# EasyEDA Pro project RN8302B-c8t6 V3.1.eprj, board PCB1
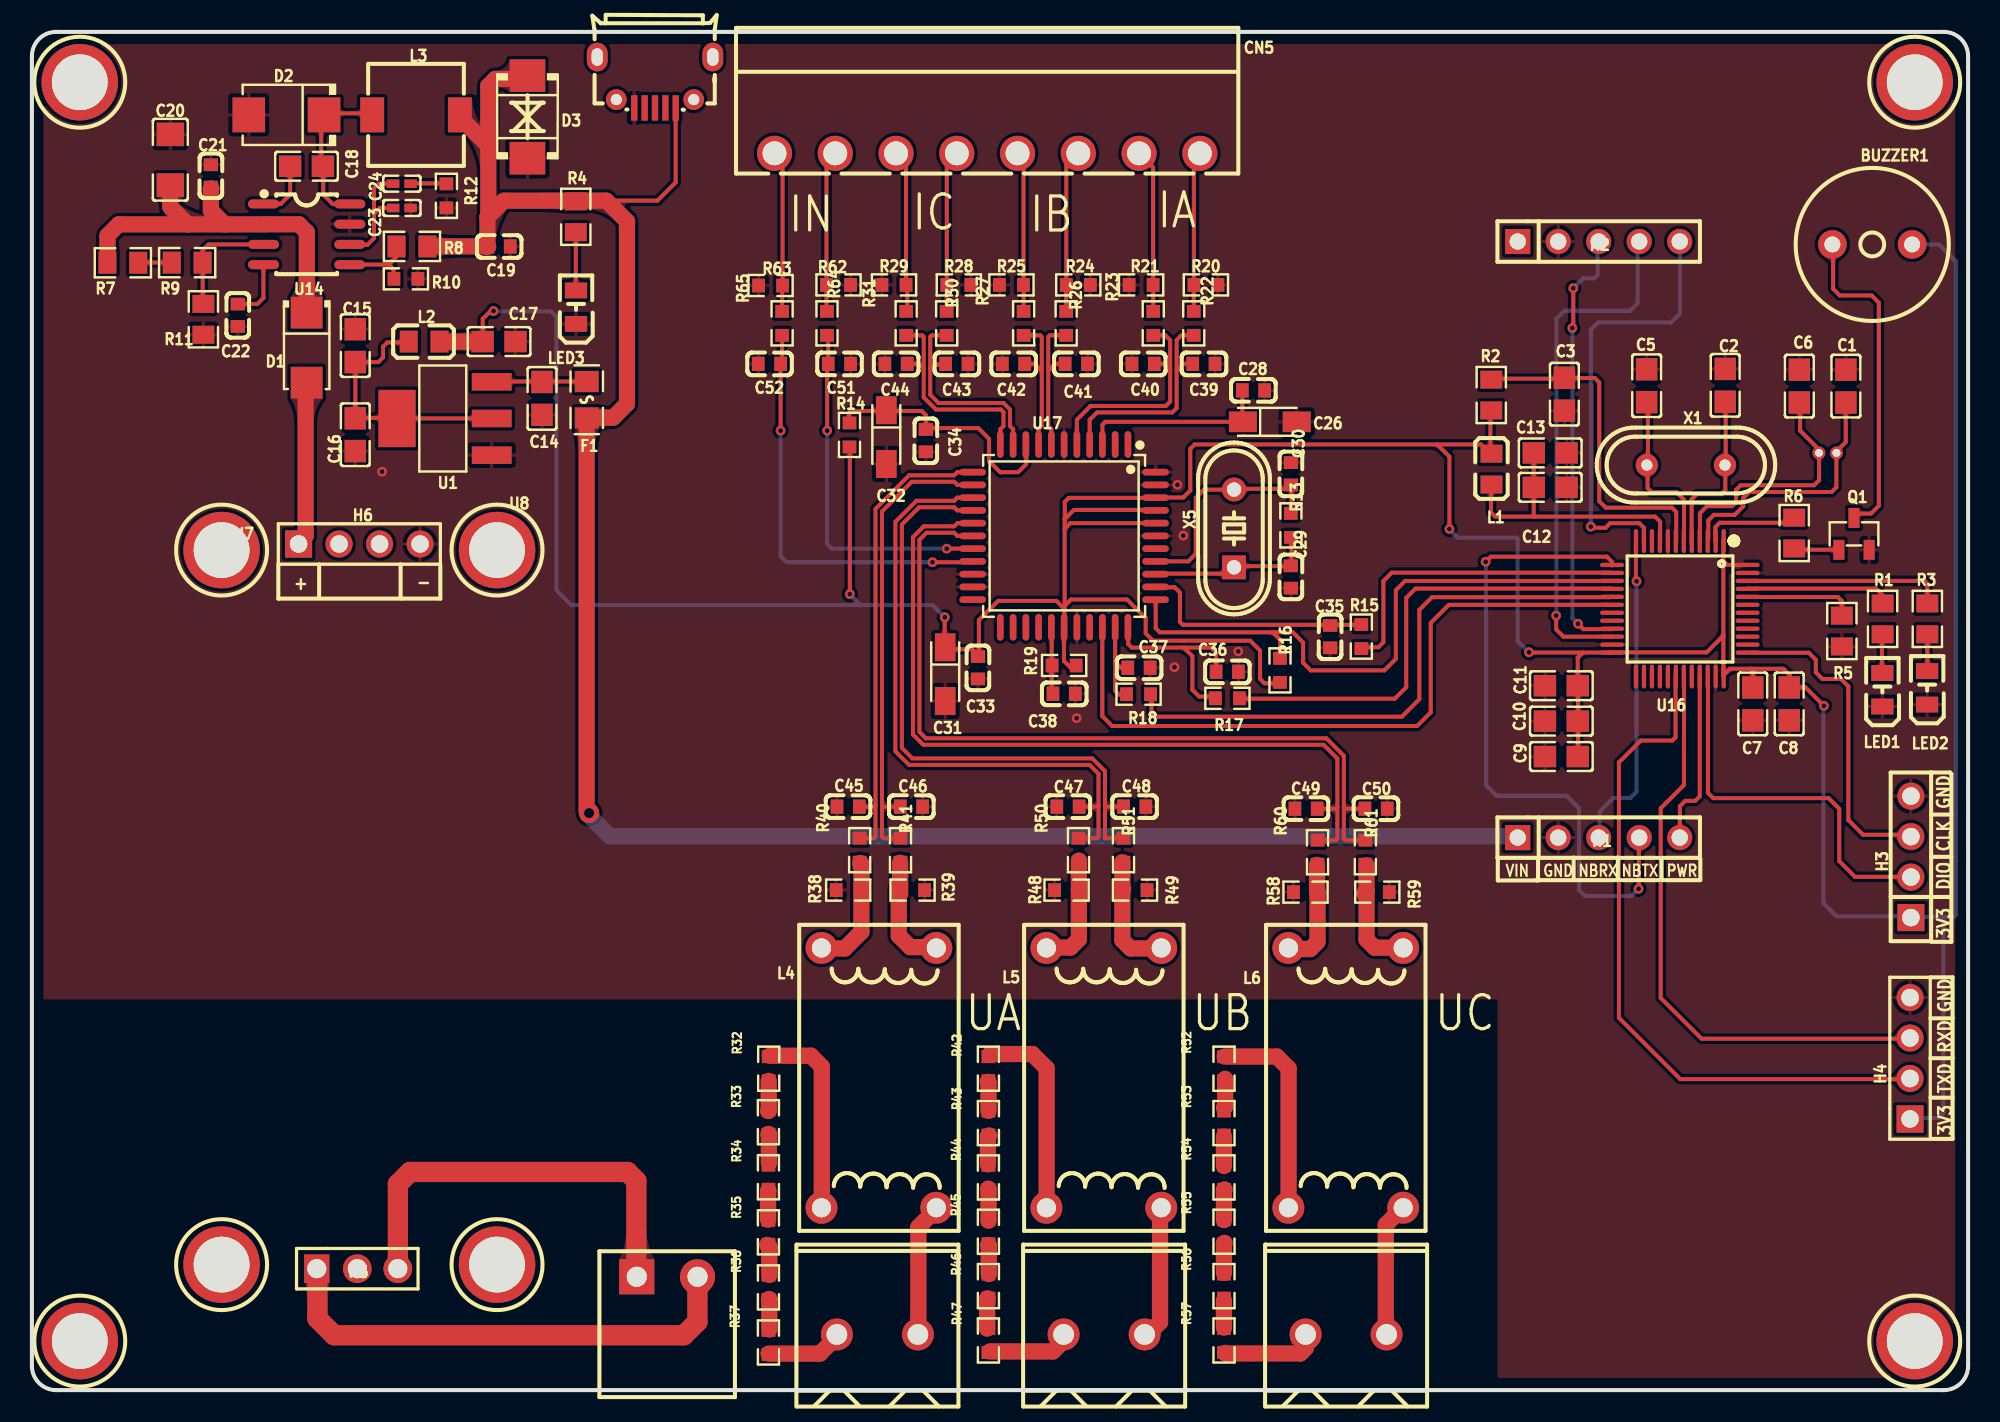
[diagram p2: board, top side]
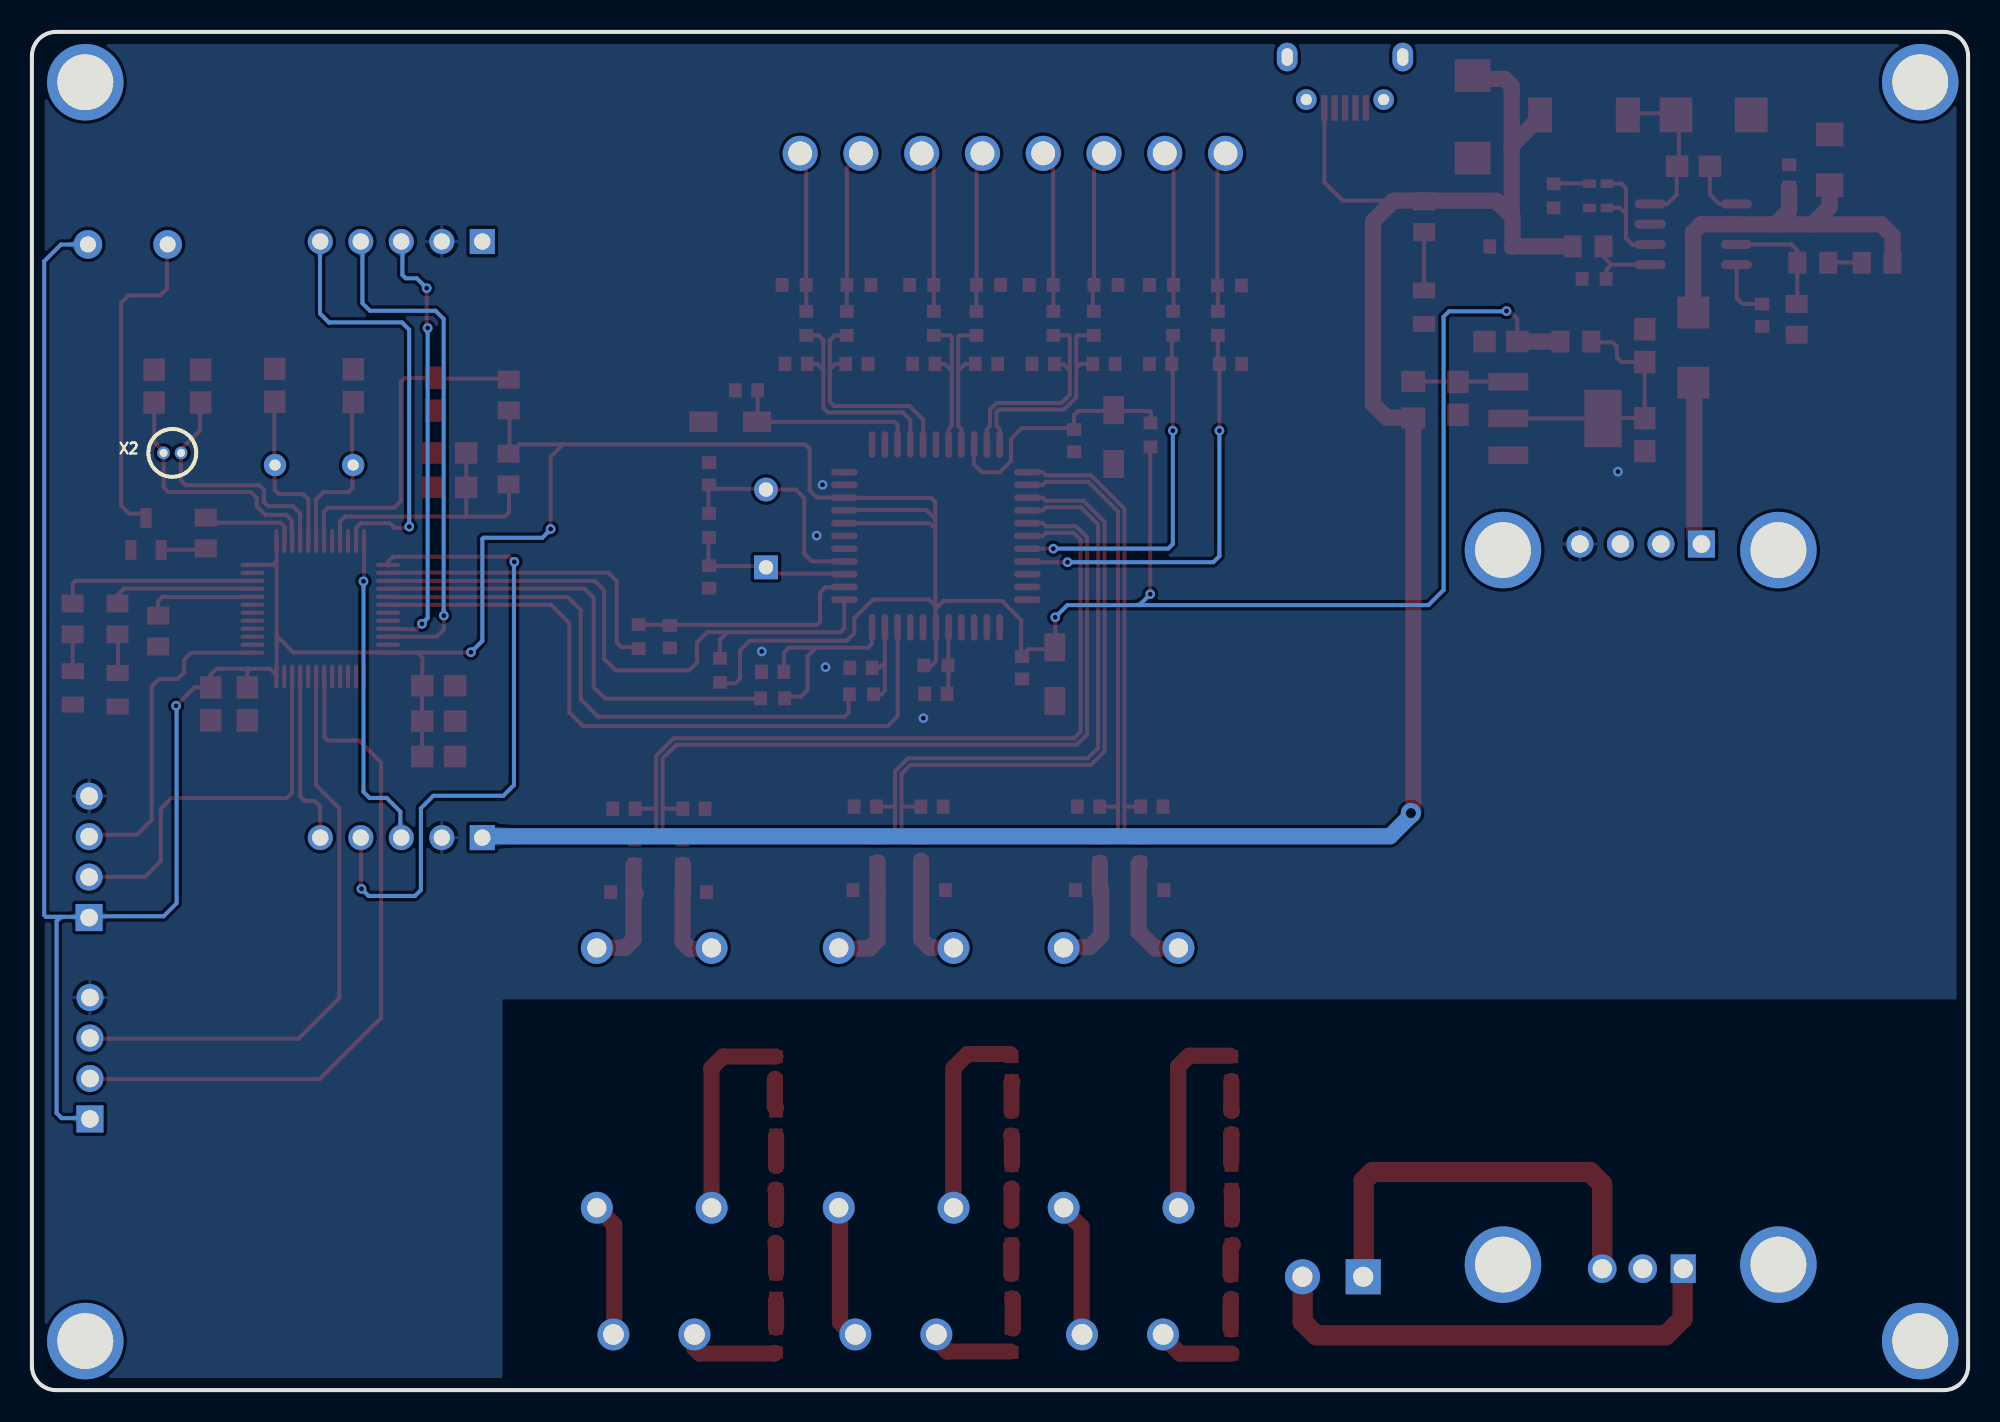
[diagram p3: board, bottom side, seen from below]

Outline 121.41 x 85.22 mm; copper layers: Top Layer, Bottom Layer. Coordinates in mm from the lower left corner of the outline.
Outline path: 0,83.69 0,1.52 arc(0.45,0.45) 1.52,0 119.89,0 arc(120.97,0.45) 121.41,1.52 121.41,83.69 arc(120.97,84.77) 119.89,85.22 1.52,85.22 arc(0.45,84.77) 0,83.69
Stack: Top Layer 0.035mm / Dielectric1 1.51mm FR4 er 4.5 / Bottom Layer 0.035mm

## Design rules (mm)
net GND: POWE
net 3V3: POWE
net VDDA: POWE
net +5V: POWE
net VIN_9V: POWE
net I1P: DP1
net I1N: DP1
net I2P: DP2
net I2N: DP2
net I3P: DP3
net I3N: DP3
net VAP: DP4
net VAN: DP4
net VBP: DP5
net VBN: DP5
net VCP: DP6
net VCN: DP6
template: 自定义配置
spacing copperThickness1oz (default): track to track 0.102, other pairs 0.152 to 0.3
spacing copperThickness2oz: track to track 0.203, other pairs 0.152 to 0.3
track width copperThickness1oz (default): min 0.127, default 0.254, max 2.54
track width copperThickness2oz: min 0.203, default 0.254, max 2.54
track width POWE: min 0.254, default 0.254, max 2.54
differential pair differentialPair (default): width min 0.127, default 0.254, max 2.54; gap min 0.152, default 0.152
via viaSize (default): diameter min 0.5, default 0.61, max 10; hole min 0.3, default 0.305, max 6.299
net class POWE uses POWE
net GND uses POWE
net 3V3 uses POWE
net VDDA uses POWE
net +5V uses POWE
net VIN_9V uses POWE

## Placement (name value [footprint] x y rotation side)
BUZZER1  KXG0903C3  [buz-th_bd9.6-p5.00-d0.7-fd]  115.4 71.88 180 top
C1  10pF  [c0805]  113.75 62.99 270 top
C2  22pF  [c0805]  106.18 63.04 270 top
C3  100nF  [c0805]  96.1 62.48 90 top
C5  22pF  [c0805]  101.26 63.02 270 top
C6  10pF  [c0805]  110.83 62.99 270 top
C7  100nF  [c0805]  107.91 43.05 90 top
C8  100nF  [c0805]  110.19 43.05 90 top
C9  100nF  [c0805]  95.91 39.75 0 top
C10  100nF  [c0805]  95.91 41.97 0 top
C11  100nF  [c0805]  95.91 44.2 0 top
C12  100nF  [c0805]  95.21 56.64 180 top
C13  22uF  [c0805]  95.21 58.8 180 top
C14  22uF  [c0805]  31.99 62.22 270 top
C15  22uF  [c0805]  20.28 65.53 90 top
C16  100nF  [c0805]  20.28 59.94 90 top
C17  22uF  [c0805]  29.29 65.79 0 top
C18  100nF  [c0805]  17.22 76.79 0 top
C19  10nF  [c0603]  29.29 71.75 180 top
C20  10uF  [c1206]  8.68 77.19 270 top
C21  10nF  [c0603]  11.22 76.18 270 top
C22  10nF  [c0603]  12.91 67.44 90 top
C23  1nF  [c0402]  23.2 74.17 180 top
C24  47pF  [c0402]  23.2 75.69 180 top
C26  10uF  [CAP-SMD_L3.2-W1.6-RD-C7171]  77.62 60.75 0 top
C28  100nF  [C0603]  76.6 62.72 0 top
C29  15pF  [C0603]  78.94 51.02 270 top
C30  15pF  [C0603]  78.95 57.49 90 top
C31  10uF  [CAP-SMD_L3.2-W1.6-RD-C7171]  57.27 44.92 270 top
C32  10uF  [CAP-SMD_L3.2-W1.6-RD-C7171]  53.58 59.79 270 top
C33  100nF  [C0603]  59.32 45.32 90 top
C34  100nF  [C0603]  56.06 59.57 90 top
C35  15pF  [C0603]  81.41 47.27 90 top
C36  15pF  [C0603]  74.96 45.07 180 top
C37  15pF  [C0603]  69.42 45.32 180 top
C38  100nF  [C0603]  64.73 43.69 180 top
C39  33nF  [C0603]  73.49 64.39 180 top
C40  33nF  [C0603]  69.68 64.39 180 top
C41  33nF  [C0603]  65.49 64.39 180 top
C42  33nF  [C0603]  61.55 64.39 180 top
C43  33nF  [C0603]  58 64.39 180 top
C44  33nF  [C0603]  54.19 64.39 180 top
C45  33nF  [C0603]  51.19 36.61 0 top
C46  33nF  [C0603]  55.15 36.61 0 top
C47  33nF  [C0603]  64.97 36.61 0 top
C48  33nF  [C0603]  69.15 36.61 0 top
C49  33nF  [C0603]  79.9 36.48 0 top
C50  33nF  [C0603]  84.29 36.48 0 top
C51  33nF  [C0603]  50.64 64.39 180 top
C52  33nF  [C0603]  46.25 64.39 180 top
CN5  WJ15EDGRC-3.81-8P  [CONN-TH_8P-P3.81_WJ15EDGRC-3.81-8P]  59.9 77.6 180 top
D1  -  [sma_l4.3-w2.6-ls5.2-rd]  17.23 65.4 270 top
D2  -  [smb_l4.6-w3.6-ls5.3-rd]  15.96 80.01 180 top
D3  -  [smb_l4.6-w3.6-ls5.3-bi]  31.07 79.88 90 top
F1  0.5A 6V  [f0805]  34.79 62.14 270 top
H1  PM254-1-05-Z-8.5  [HDR-TH_5P-P2.54-V-F]  98.25 34.67 0 top
H2  PM254-1-05-Z-8.5  [HDR-TH_5P-P2.54-V-F]  98.25 72.06 0 top
H3  -  [hdr-th_4p-p2.54-v-m]  117.83 33.46 90 top
H4  -  [hdr-th_4p-p2.54-v-m-1]  117.77 20.82 90 top
H5  Z-211-0311-0021-001  [hdr-th_3p-p2.54-v-m-1_1]  20.4 7.62 0 top
H6  -  [hdr-th_4p-p2.54-v-m-1]  20.53 53.09 0 top
L1  10uH  [l0805]  91.52 57.78 270 top
L2  10uH  [l0805]  24.6 65.79 0 top
L3  6.8uH  [ind-smd_l6.0-w6.0_slf6025]  24.09 80.01 0 top
L4  ZMPT107-1  [XFMR-TH_ZMPT107-1]  53.11 19.59 90 top
L5  ZMPT107-1  [XFMR-TH_ZMPT107-1]  67.22 19.59 90 top
L6  ZMPT107-1  [XFMR-TH_ZMPT107-1]  82.39 19.59 90 top
LED1  RED  [led0805-r-rd]  116.04 43.94 90 top
LED2  BLUE  [led0805-r-rd]  118.84 44.06 90 top
LED3  RED  [led0805-r-rd]  34.12 67.94 90 top
P1  WJ15EDGRC-3.81-2P  [conn-th_2p-p3.81_wj15edgrc-3.81-2p]  39.84 7.11 0 top
P2  WJ500V-5.08-2P  [CONN-TH_2P-P5.00_WJ500V-5.08-2P]  53.02 3.49 0 top
P3  WJ500V-5.08-2P  [CONN-TH_2P-P5.00_WJ500V-5.08-2P]  67.24 3.49 0 top
P4  WJ500V-5.08-2P  [CONN-TH_2P-P5.00_WJ500V-5.08-2P]  82.41 3.49 0 top
Q1  S8050  [sot-23-3_l2.9-w1.3-p1.90-ls2.4-br]  114.26 53.72 270 top
R1  470  [r0805]  116.05 48.39 270 top
R2  10k  [r0805]  91.51 62.43 270 top
R3  470  [r0805]  118.86 48.39 270 top
R4  1k  [r0805]  34.11 73.62 90 top
R5  10k  [r0805]  113.5 47.62 90 top
R6  330  [r0805]  110.51 53.77 90 top
R7  2k  [r0805]  5.7 70.73 180 top
R8  51k  [r0805]  23.83 71.75 0 top
R9  330k  [r0805]  9.74 70.74 180 top
R10  10k  [r0603]  23.45 69.72 180 top
R11  51k  [r0805]  10.75 67.18 90 top
R12  -  [r0603]  25.99 74.93 270 top
R13  10MΩ  [R0603]  78.95 54.25 270 top
R14  10Ω  [R0603]  51.27 59.93 90 top
R15  10Ω  [R0603]  83.36 47.28 270 top
R16  10kΩ  [R0603]  78.26 45.16 270 top
R17  10Ω  [R0603]  74.97 43.4 0 top
R18  10Ω  [R0603]  69.39 43.66 0 top
R19  10kΩ  [R0603]  64.73 45.47 180 top
R20  3Ω  [R0603]  73.62 69.34 180 top
R21  3Ω  [R0603]  69.55 69.34 180 top
R22  1kΩ  [R0603]  72.86 66.93 270 top
R23  1kΩ  [R0603]  70.32 66.93 270 top
R24  3Ω  [R0603]  65.62 69.34 180 top
R25  3Ω  [R0603]  61.43 69.34 180 top
R26  1kΩ  [R0603]  64.85 66.93 270 top
R27  1kΩ  [R0603]  62.19 66.93 270 top
R28  3Ω  [R0603]  58.12 69.34 180 top
R29  3Ω  [R0603]  54.06 69.34 180 top
R30  1kΩ  [R0603]  57.36 66.93 270 top
R31  1kΩ  [R0603]  54.82 66.93 270 top
R32  33kΩ  [R0603]  46.2 20.17 270 top
R33  33kΩ  [R0603]  46.19 16.81 270 top
R34  33kΩ  [R0603]  46.19 13.36 270 top
R35  33kΩ  [R0603]  46.19 9.9 270 top
R36  33kΩ  [R0603]  46.19 6.45 270 top
R37  33kΩ  [R0603]  46.19 2.99 270 top
R38  49.9Ω  [R0603]  51.19 31.37 0 top
R39  49.9Ω  [R0603]  55.22 31.37 0 top
R40  1kΩ  [R0603]  51.91 33.88 90 top
R41  1kΩ  [R0603]  54.47 33.88 90 top
R42  33kΩ  [R0603]  59.98 20.17 270 top
R43  33kΩ  [R0603]  59.98 16.76 270 top
R44  33kΩ  [R0603]  59.98 13.35 270 top
R45  33kΩ  [R0603]  59.98 9.94 270 top
R46  33kΩ  [R0603]  59.98 6.53 270 top
R47  33kΩ  [R0603]  59.98 3.12 270 top
R48  49.9Ω  [R0603]  64.88 31.37 0 top
R49  49.9Ω  [R0603]  69.17 31.37 0 top
R50  1kΩ  [R0603]  65.63 33.88 90 top
R51  1kΩ  [R0603]  68.45 33.88 90 top
R52  33kΩ  [R0603]  74.75 20.17 270 top
R53  33kΩ  [R0603]  74.75 16.76 270 top
R54  33kΩ  [R0603]  74.75 13.35 270 top
R55  33kΩ  [R0603]  74.75 9.94 270 top
R56  33kΩ  [R0603]  74.75 6.53 270 top
R57  33kΩ  [R0603]  74.75 3.12 270 top
R58  49.9Ω  [R0603]  79.86 31.24 0 top
R59  49.9Ω  [R0603]  84.36 31.24 0 top
R60  1kΩ  [R0603]  80.62 33.75 90 top
R61  1kΩ  [R0603]  83.62 33.75 90 top
R62  3Ω  [R0603]  50.58 69.34 180 top
R63  3Ω  [R0603]  46.32 69.3 180 top
R64  1kΩ  [R0603]  49.86 66.93 270 top
R65  1kΩ  [R0603]  47.04 66.93 270 top
U1  -  [sot-223-3_l6.5-w3.4-p2.30-ls7.0-br]  25.87 60.96 0 top
U3  -  [smd_bd4.2-l4.7-w4.7-d3.0]  118.06 82.06 0 top
U4  -  [smd_bd4.2-l4.7-w4.7-d3.0]  118.06 3.08 0 top
U5  -  [smd_bd4.2-l4.7-w4.7-d3.0]  3 3.08 0 top
U6  -  [smd_bd4.2-l4.7-w4.7-d3.0]  3 82.06 0 top
U7  -  [smd_bd4.2-l4.7-w4.7-d3.0]  11.9 52.7 180 top
U8  -  [smd_bd4.2-l4.7-w4.7-d3.0]  29.17 52.7 180 top
U9  -  [smd_bd4.2-l4.7-w4.7-d3.0]  29.17 7.87 0 top
U10  -  [smd_bd4.2-l4.7-w4.7-d3.0]  11.9 7.87 0 top
U14  -  [soic-8_l5.0-w4.0-p1.27-ls6.0-bl]  17.23 72.52 270 top
U16  STM32F103C8T6  [lqfp-48_l7.0-w7.0-p0.50-ls9.0-bl_4]  103.34 49.02 180 top
U17  RN8302B  [LQFP-44_L10.0-W10.0-P0.80-LS12.0-BL]  64.73 53.59 180 top
USB2  MicroXNJ  [micro-usb-smd_microxnj_1]  39.07 82.04 180 top
X1  8MHz  [osc-th_l11.1-w4.7-p4.88]  103.72 58.04 0 top
X2  32.768KHz  [osc-th_bd3.0-p1.10-d0.4]  112.61 58.8 0 bottom
X5  8.192MHz  [HC-49US_L11.5-W4.5-P4.88]  75.38 54.06 90 top

## Footprints (pads in the part's own frame, mm; a bottom-side part is the same pattern mirrored in y, then rotated)
buz-th_bd9.6-p5.00-d0.7-fd
  round 1.8 hole 1: 1(-2.5,0) 2(2.5,0)
c0402
  rect 0.79x0.54 smd: 1(-0.545,0) 2(0.545,0)
C0603
  rect 0.8x0.9 smd: 1(-0.7,0) 2(0.7,0)
c0603
  rect 0.8x0.9 smd: 1(-0.7,0) 2(0.7,0)
c0805
  rect 1.41x1.35 smd: 1(-1.03,0) 2(1.03,0)
c1206
  rect 1.485x1.728 smd: 1(-1.593,0) 2(1.593,0)
CAP-SMD_L3.2-W1.6-RD-C7171
  rect 1.758x1.296 smd: 1(-1.687,0) 2(1.687,0)
conn-th_2p-p3.81_wj15edgrc-3.81-2p
  rect 2.2x2.2 hole 1.26: 1(-1.905,0)
  round 2.2 hole 1.26: 2(1.905,0)
CONN-TH_2P-P5.00_WJ500V-5.08-2P
  round 2 hole 1.3: 1(-2.54,0) 2(2.54,0)
CONN-TH_8P-P3.81_WJ15EDGRC-3.81-8P
  round 2.2 hole 1.5: 1(-13.335,0) 2(-9.525,0) 3(-5.715,0) 4(-1.905,0) 5(1.905,0) 6(5.715,0) 7(9.525,0) 8(13.335,0)
f0805
  rect 1.335x1.5 smd: 1(-1.143,0) 2(1.143,0)
HC-49US_L11.5-W4.5-P4.88
  rect 1.5x1.5 hole 0.9: 1(-2.44,0)
  round 1.5 hole 0.9: 2(2.44,0)
hdr-th_3p-p2.54-v-m-1_1
  rect 1.575x1.8 hole 1.2: 1(-2.54,0)
  round 1.8 hole 1.2: 2(0,0) 3(2.54,0)
hdr-th_4p-p2.54-v-m
  rect 1.7x1.7 hole 1.1: 1(-3.81,0)
  round 1.7 hole 1.1: 2(-1.27,0) 3(1.27,0) 4(3.81,0)
hdr-th_4p-p2.54-v-m-1
  rect 1.7x1.7 hole 1.1: 1(-3.81,0)
  round 1.7 hole 1.1: 2(-1.27,0) 3(1.27,0) 4(3.81,0)
HDR-TH_5P-P2.54-V-F
  rect 1.575x1.575 hole 1.02: 1(-5.08,0)
  round 1.575 hole 1.02: 2(-2.54,0) 3(0,0) 4(2.54,0) 5(5.08,0)
ind-smd_l6.0-w6.0_slf6025
  rect 1.501x2.2 smd: 1(-2.751,0) 2(2.751,0)
l0805
  rect 1.133x1.377 smd: 1(-0.966,0) 2(0.966,0)
led0805-r-rd
  rect 1x1.399 smd: 1(1.05,0) 2(-1.05,0)
LQFP-44_L10.0-W10.0-P0.80-LS12.0-BL
  oval 0.42x1.67 smd: 1(-4,-5.735) 2(-3.2,-5.735) 3(-2.4,-5.735) 4(-1.6,-5.735) 5(-0.8,-5.735) 6(0,-5.735) 7(0.8,-5.735) 8(1.6,-5.735) 9(2.4,-5.735) 10(3.2,-5.735) 11(4,-5.735) 23(4,5.735) 24(3.2,5.735) 25(2.4,5.735) 26(1.6,5.735) 27(0.8,5.735) 28(0,5.735) 29(-0.8,5.735) 30(-1.6,5.735) 31(-2.4,5.735) 32(-3.2,5.735) 33(-4,5.735)
  oval 1.67x0.42 smd: 12(5.735,-4) 13(5.735,-3.2) 14(5.735,-2.4) 15(5.735,-1.6) 16(5.735,-0.8) 17(5.735,0) 18(5.735,0.8) 19(5.735,1.6) 20(5.735,2.4) 21(5.735,3.2) 22(5.735,4) 34(-5.735,4) 35(-5.735,3.2) 36(-5.735,2.4) 37(-5.735,1.6) 38(-5.735,0.8) 39(-5.735,0) 40(-5.735,-0.8) 41(-5.735,-1.6) 42(-5.735,-2.4) 43(-5.735,-3.2) 44(-5.735,-4)
lqfp-48_l7.0-w7.0-p0.50-ls9.0-bl_4
  oval 0.27x1.5 smd: 1(-2.75,-4.25) 2(-2.25,-4.25) 3(-1.75,-4.25) 4(-1.25,-4.25) 5(-0.75,-4.25) 6(-0.25,-4.25) 7(0.25,-4.25) 8(0.75,-4.25) 9(1.25,-4.25) 10(1.75,-4.25) 11(2.25,-4.25) 12(2.75,-4.25) 25(2.75,4.25) 26(2.25,4.25) 27(1.75,4.25) 28(1.25,4.25) 29(0.75,4.25) 30(0.25,4.25) 31(-0.25,4.25) 32(-0.75,4.25) 33(-1.25,4.25) 34(-1.75,4.25) 35(-2.25,4.25) 36(-2.75,4.25)
  oval 1.5x0.27 smd: 13(4.25,-2.75) 14(4.25,-2.25) 15(4.25,-1.75) 16(4.25,-1.25) 17(4.25,-0.75) 18(4.25,-0.25) 19(4.25,0.25) 20(4.25,0.75) 21(4.25,1.25) 22(4.25,1.75) 23(4.25,2.25) 24(4.25,2.75) 37(-4.25,2.75) 38(-4.25,2.25) 39(-4.25,1.75) 40(-4.25,1.25) 41(-4.25,0.75) 42(-4.25,0.25) 43(-4.25,-0.25) 44(-4.25,-0.75) 45(-4.25,-1.25) 46(-4.25,-1.75) 47(-4.25,-2.25) 48(-4.25,-2.75)
micro-usb-smd_microxnj_1
  rect 0.4x1.6 smd: 1(-1.3,1.597) 2(-0.65,1.597) 3(0,1.597) 4(0.65,1.597) 5(1.3,1.597)
  round 1.3 hole 0.7: 6(2.425,1.074) 9(-2.425,1.073)
  oval 1.3x1.8 hole 0.7x1.1: 7(3.625,-1.597) 8(-3.625,-1.597)
osc-th_bd3.0-p1.10-d0.4
  round 0.8 hole 0.5: 1(-0.548,0) 2(0.551,0)
osc-th_l11.1-w4.7-p4.88
  round 1.4 hole 0.7: 1(-2.45,0) 2(2.45,0)
R0603
  rect 0.806x0.864 smd: 1(-0.753,0) 2(0.753,0)
r0603
  rect 0.806x0.864 smd: 1(-0.753,0) 2(0.753,0)
r0805
  rect 1.133x1.377 smd: 1(-0.966,0) 2(0.966,0)
sma_l4.3-w2.6-ls5.2-rd
  rect 2x2 smd: 1(-2.2,0) 2(2.2,0)
smb_l4.6-w3.6-ls5.3-bi
  rect 2.047x2.241 smd: 1(-2.591,0) 2(2.591,0)
smb_l4.6-w3.6-ls5.3-rd
  rect 2.047x2.192 smd: 1(-2.361,0) 2(2.361,0)
smd_bd4.2-l4.7-w4.7-d3.0
  round 4.8 hole 3.5: 1(0,0)
soic-8_l5.0-w4.0-p1.27-ls6.0-bl
  oval 0.569x1.95 smd: 1(-1.905,-2.705) 2(-0.635,-2.705) 3(0.635,-2.705) 4(1.905,-2.705) 5(1.905,2.705) 6(0.635,2.705) 7(-0.635,2.705) 8(-1.905,2.705)
sot-23-3_l2.9-w1.3-p1.90-ls2.4-br
  rect 1.25x0.7 smd: 1(1,-0.95) 2(1,0.95) 3(-1,0)
sot-223-3_l6.5-w3.4-p2.30-ls7.0-br
  rect 2.5x1.1 smd: 1(2.97,-2.3) 2(2.97,0) 3(2.97,2.3)
  rect 2.34x3.6 smd: 4(-2.97,0)
XFMR-TH_ZMPT107-1
  round 2 hole 1.2: 1(-8.15,3.6) 2(-8.15,-3.6) 3(8.15,3.6) 4(8.15,-3.6)

## Nets
As in the schematic.

Pads without a net: H2 1; H5 2; H6 2 3; U3 1; U4 1; U5 1; U6 1; U7 1; U8 1; U9 1; U10 1; U16 10 19 20 25 26 27 28 29 32 38 39 40 41 42 43; U17 1 2 22 23 24 25 26 30 38; USB2 2 3 4 6 7 8 9

## Via types
v1: diameter 0.61, hole 0.305, Top Layer to Bottom Layer, 24 vias
v2: diameter 1.27, hole 0.635, Top Layer to Bottom Layer, 1 via

## Routing (per net, layer and track width the routed paths; a pad name or vN(x,y) marks a point on that pad's centre or on a via; arc(x,y) is an arc through that point)
3V3: length 284
  Top Layer w0.254: 110.18,44.07 110.22,44.12 110.22,44.86 109.83,45.26 107.79,45.26 ; 91.54,58.66 90.86,59.33 88.12,59.33 ; 88.12,59.33 72.91,59.33 72.64,59.06 72.64,56.44 72.2,56 70.3,56 ; 88.12,59.33 88.89,58.57 v1(88.89,54.03) ; 64.76,54.04 65.11,54.39 70.47,54.39 70.49,54.42 ; 64.76,54.04 64.76,54.65 64.77,54.65 ; 64.76,54.04 64.76,49.2 ; 91.46,61.7 91.46,58.86 91.53,58.79 ; 106.07,44.84 106.47,45.24 106.47,45.26 107.79,45.26 ; 106.07,44.84 106.07,47.33 ; 106.07,44.84 106.07,44.83 ; 106.07,52.01 106.07,47.33 ; 106.07,52.01 106.3,51.78 107.56,51.78 ; 106.07,52.01 106.07,53.32 ; 106.07,47.33 105.02,46.29 99.07,46.29 ; 96.93,44.02 96.93,45.96 97.25,46.28 ; 96.93,44.02 96.95,44 96.95,39.77 96.97,39.75 ; 96.93,44.02 96.9,43.98 ; v1(28.95,67.7) 28.76,67.7 28.27,67.21 28.27,65.92 28.33,65.86 ; 64.74,49.02 64.24,49.52 60.59,49.52 59.38,48.31 59.38,46.05 58.95,46.48 57.24,46.48 57.24,48.4 ; 64.74,49.02 64.75,49.01 ; 64.74,49.02 64.74,47.79 ; 107.79,45.26 107.91,45.14 107.91,44.04 107.9,44.03 ; 70.47,55.98 65.02,55.98 64.77,55.73 64.77,54.65 ; 64.77,54.65 64.77,54.5 ; 64.77,54.65 65.34,55.22 70.49,55.22 ; 64.76,49.2 65.16,49.6 68.67,49.6 69.84,48.43 69.84,47.48 70.3,47.02 76.39,47.02 77.01,46.4 77.01,44.62 77.29,44.35 78.22,44.35 ; 64.76,49.2 64.76,49.12 ; 64.76,49.2 64.68,49.12 ; 110.22,44.1 111.21,44.1 v1(112.37,42.93) ; 65.46,45.35 65.11,45.35 64.72,45.74 64.72,47.8 ; 51.19,59.22 51.29,59.12 v1(51.29,49.94) ; 99.15,46.28 97.25,46.28 ; 97.25,46.28 93.9,46.28 93.9,46.27 ; 78.28,44.35 78.28,44.35 78.22,44.35 ; 78.28,44.35 78.31,44.31 ; 78.28,44.35 78.22,44.35
  Top Layer w1.016: 25.57,65.78 28.24,65.78 28.27,65.81
  Bottom Layer w0.254: 117.81,29.73 113.16,29.73 112.34,30.55 112.34,42.86 ; v1(93.88,46.29) 93.17,47.01 93.17,53.4 93.09,53.48 89.4,53.48 88.89,54 ; 51.96,49.25 56.48,49.25 v1(57.24,48.49) ; 51.96,49.25 33.84,49.25 32.89,50.2 32.89,67.35 32.55,67.68 28.95,67.68 ; 51.96,49.25 51.29,49.93 ; 117.75,17.06 119.55,17.06 119.86,17.38 119.86,29.42 119.59,29.69 ; 117.87,71.94 117.94,71.88 119.59,71.88 120.64,70.82 120.64,29.81 120.53,29.69 119.59,29.69 ; 119.59,29.69 117.78,29.69
+5V: length 136.4
  Top Layer w0.254: 36.02,74.63 39.23,74.63 40.37,75.77 40.37,80.52
  Top Layer w1.016: 28.62,78.08 28.62,81.82 29.06,82.27 30.9,82.27 31.09,82.46 ; 28.62,78.08 26.71,79.98 ; 28.62,78.08 28.62,73.65 ; 28.62,73.65 29.59,74.63 34.15,74.63 ; 28.62,73.65 28.62,73.63 ; 28.62,73.65 28.57,73.6 28.57,71.77 28.55,71.76 ; 28.61,71.73 28.58,71.76 28.55,71.76 ; 24.82,71.76 28.55,71.76 ; v2(34.94,36.2) 34.79,36.36 34.79,60.83 ; 34.15,74.63 36.02,74.63 37.32,73.33 37.32,61.88 36.45,61.01 34.78,61.01
  Bottom Layer w1.016: 35,36 36.25,34.75 93.18,34.75 93.27,34.66
GND:
  vias: v1(21.96,57.63) v1(65.51,42.16) v1(71.65,45.36) v1(71.83,56.8) v1(72.2,53.61) v1(75.65,46.35)
VDDA: length 16
  Top Layer w0.254: 60.74,57.57 60.02,58.29 60.02,59.68 59.34,60.36 56.04,60.36 56.07,60.38 56.07,61.16 55.8,61.43 51.32,61.43 51.24,61.36 51.24,60.84 ; 62.35,59.3 62.35,58.1 61.85,57.59 60.74,57.59
VDDA_32: length 17.9
  Top Layer w0.254: 94.25,54.81 94.17,54.89 94.17,58.83 94.16,58.84 ; 94.25,54.81 91.76,54.81 91.49,55.08 91.49,56.78 ; 94.25,54.81 94.26,54.8 ; 102.1,53.26 102.1,54.49 101.79,54.81 94.26,54.81
VIN_9V: length 25.4
  Top Layer w1.016: 14.55,73.14 16.75,73.14 17.24,72.65 17.24,67.63 17.19,67.58 ; 11.26,75.39 11.22,75.36 11.22,74.01 12.09,73.14 ; 9.77,73.14 8.68,74.23 8.68,75.6 ; 9.77,73.14 5.44,73.14 4.74,72.43 4.74,70.71 4.72,70.7 ; 9.77,73.14 12.09,73.14 ; 12.09,73.14 14.53,73.14
CLK: length 12.4
  Top Layer w0.254: 74.14,43.45 74.07,43.52 73.19,43.52 72.77,43.94 72.77,46.05 72.23,46.59 ; 72.23,46.59 68.97,46.59 68.75,46.8 68.75,47.89 ; 72.23,46.59 73.94,46.59 74.26,46.27 74.26,45.18 74.24,45.16 ; 74.18,43.64 74.21,43.67
CS: length 39.1
  Top Layer w0.254: 99.11,50.77 86.11,50.77 85.53,50.19 85.53,45.88 84.81,45.16 80.19,45.16 79.71,45.64 79.71,46.9 79.07,47.55 77.84,47.55 ; 78.28,45.77 78.27,45.78 78.27,47.09 77.81,47.55 70.72,47.55 70.47,47.8 70.47,49.6
DI: length 15.1
  Top Layer w0.254: 83.39,47.99 83.36,48.01 81.33,48.01 ; 70.42,50.37 71.66,50.37 71.99,50.04 71.99,48.2 72.17,48.01 81.33,48.01 ; 81.33,48.01 81.4,47.95
DO: length 5.8
  Top Layer w0.254: 67.93,45.67 67.93,43.87 68.15,43.65 68.67,43.65 68.69,43.66 ; 67.93,45.67 68.3,45.3 68.67,45.3 68.72,45.35 ; 67.93,45.67 67.93,47.85
I1N: length 14.1
  Top Layer w0.254: 71.38,64.03 71.02,64.39 C40.1 ; 71.38,64.03 71.38,65.88 71.08,66.18 R23.2 ; 71.38,64.03 71.38,62.02 71.1,61.75 66.39,61.75 65.53,60.89 U17.5
I1N_IN: length 10.3
  Top Layer w0.254: R23.1 70.32,69.33 R21.1 70.31,76.72 CN5.2
I1P: length 13.9
  Top Layer w0.254: U17.4 66.33,60.88 66.79,61.34 71.51,61.34 71.78,61.61 71.78,63.99 ; C39.2 72.18,64.39 71.78,63.99 ; 71.78,63.99 71.78,65.88 72.08,66.18 R22.2
I1P_IN: length 10.1
  Top Layer w0.254: R22.1 72.86,69.33 R20.2 72.86,77.22 73.24,77.6
I2N: length 9.2
  Top Layer w0.254: U17.8 63.13,60.29 63.32,60.49 63.32,66.09 63.23,66.18 R27.2 ; 63.32,63.99 63.28,63.99 62.88,64.39 C42.1
I2N_IN: length 10.1
  Top Layer w0.254: CN5.4 62.18,77.22 R25.1 62.19,69.33 R27.1
I2P: length 9.2
  Top Layer w0.254: C41.2 64.16,64.39 63.81,64.04 63.74,64.04 ; U17.7 63.93,60.29 63.73,60.49 63.73,66.09 63.82,66.18 R26.2
I2P_IN: length 10.2
  Top Layer w0.254: CN5.3 64.86,76.84 R24.2 64.85,69.33 R26.1
I3N: length 13.6
  Top Layer w0.254: 55.91,64.12 55.64,64.39 C44.1 ; U17.11 60.73,60.29 60.92,60.49 60.92,61.36 60.76,61.53 56.68,61.53 55.92,62.29 55.92,66.09 55.83,66.18 R31.2
I3N_IN: length 10.1
  Top Layer w0.254: CN5.6 54.81,76.97 R29.1 ; 54.89,67.74 54.89,69.34
I3P: length 13.5
  Top Layer w0.254: 56.33,64.09 56.33,66.09 56.42,66.18 R30.2 ; 56.33,64.09 56.44,64.09 56.7,64.34 57.25,64.34 57.3,64.39 ; 56.33,64.09 56.33,62.45 56.85,61.93 60.92,61.93 61.33,61.53 61.33,60.49 61.53,60.29 U17.10
I3P_IN: length 10.2
  Top Layer w0.254: CN5.5 57.37,76.97 R28.2 57.36,69.33 R30.1
INN: length 26.1
  Top Layer w0.254: 46.95,60.2 C52.1 47.04,64.48 R65.2 ; 58.99,51.99 58.94,51.94 v1(56.47,51.94)
  Bottom Layer w0.254: v1(46.95,60.2) 46.95,52.32 47.33,51.94 v1(56.47,51.94)
INN_IN: length 10.1
  Top Layer w0.254: CN5.8 47.07,77.09 R63.1 47.04,69.27 R65.1
INP: length 22.4
  Top Layer w0.254: U17.18 v1(57.36,52.79) ; R64.2 49.94,66.1 C51.2 49.87,64.32 v1(49.87,60.2)
  Bottom Layer w0.254: v1(49.87,60.2) 49.87,53.09 50.16,52.79 v1(57.36,52.79)
INP_IN: length 10.2
  Top Layer w0.254: R64.1 49.83,67.71 R62.2 49.83,77.05 CN5.7
INTIN: length 44.2
  Top Layer w0.254: 67.12,47.8 67.12,42.28 67.74,41.67 86.86,41.67 87.72,42.52 87.72,48.13 88.85,49.27 99.1,49.27
L_IN: length 26.9
  Top Layer w1.27: 37.9,7.07 37.9,13.13 37.35,13.69 23.71,13.69 22.95,12.93 22.95,7.6
LED1: length 8.6
  Top Layer w0.254: 107.58,50.29 115.64,50.29 116.04,49.89
LED2: length 12.6
  Top Layer w0.254: 107.57,50.77 118.69,50.77 118.85,50.6 118.85,49.37
N: length 30.6
  Top Layer w1.27: 41.75,7.12 41.73,7.11 41.73,4.29 40.88,3.44 18.95,3.44 17.9,4.49 17.9,7.64
NRST: length 21.6
  Top Layer w0.254: 91.53,63.46 96.24,63.46 96.28,63.5 ; 96.28,63.5 98.01,63.5 98.28,63.22 98.28,55.77 98.69,55.37 102.84,55.37 103.11,55.1 103.11,53.23 ; 96.28,63.5 96.01,63.5
OSC32_IN: length 16
  Top Layer w0.254: 113.2,58.77 113.15,58.73 113.15,56.65 112.85,56.35 107.69,56.35 107.31,55.97 107.31,55.45 106.78,54.91 105.47,54.91 105.12,54.56 105.12,53.38 ; 113.74,62.01 113.74,59.48 113.1,58.84
OSC32_OUT: length 15.8
  Top Layer w0.254: 110.87,61.93 110.87,60.2 112.12,58.95 112.12,58.92 ; 104.6,53.23 104.6,55.02 105.04,55.46 106.61,55.46 106.86,55.72 106.86,56.48 107.15,56.77 111.76,56.77 112.07,57.09 112.07,58.78 112.06,58.79
OSC_IN: length 10.9
  Top Layer w0.254: 106.06,58.07 106.16,58.18 ; 106.16,58.18 106.19,58.15 106.19,56.47 105.93,56.21 104.4,56.21 104.08,55.89 104.08,53.12 ; 106.16,58.18 106.21,58.23 106.21,62.05
OSC_OUT: length 10.6
  Top Layer w0.254: 101.31,58.05 101.31,56.59 101.57,56.34 103.12,56.34 103.6,55.86 103.6,53.22 103.57,53.2 ; 101.26,61.89 101.34,61.82 101.34,58.02
PA1: length 27.5
  Top Layer w0.254: 101.08,53.22 101.08,54.1 100.79,54.39 98.97,54.39 98.68,54.1 97.83,54.1 v1(97.75,54.18)
  Bottom Layer w0.254: 103.35,72.01 103.35,67.55 102.77,66.98 102.77,66.99 98.21,66.99 97.75,66.53 97.75,54.01
PA2: length 20.2
  Top Layer w0.254: v1(100.62,50.74) 100.58,50.78 100.58,53.32
  Bottom Layer w0.254: 98.31,34.69 98.31,36.3 99.17,37.16 100.24,37.16 100.62,37.54 100.62,50.74
PA3: length 41
  Top Layer w0.254: v1(91.16,51.97) 91.48,52.29 98.76,52.29 99.08,51.97 99.08,51.74 ; 100.81,31.67 100.77,31.71 100.77,34.6
  Bottom Layer w0.254: v1(91.16,51.97) 91.19,51.95 91.19,37.96 91.85,37.29 96.24,37.29 97.02,36.51 97.02,31.37 97.39,31 100.3,31 v1(100.75,31.45)
PA9: length 44
  Top Layer w0.254: 99.52,23.35 99.52,39.38 100.89,40.75 102.86,40.75 103.07,40.96 103.07,44.76 103.09,44.78 ; 117.87,19.51 103.36,19.51 99.52,23.35
PA10: length 37.5
  Top Layer w0.254: 103.6,44.81 103.6,40.98 103.59,40.97 103.59,37.96 102.14,36.5 102.14,24.61 104.69,22.05 117.79,22.05
PA12: length 11
  Top Layer w0.254: 104.59,44.78 104.59,37.26 104.3,36.97 103.67,36.97 103.34,36.64 103.34,34.71
PA13: length 24.1
  Top Layer w0.254: 117.84,32.2 114.32,32.2 113.33,33.19 113.33,36.47 112.66,37.14 105.43,37.14 105.1,37.47 105.1,44.7
PA14: length 20
  Top Layer w0.254: 107.85,46.26 111.42,46.26 111.86,45.82 111.86,45.03 112.27,44.62 113.44,44.62 113.9,44.16 113.9,35.77 114.82,34.84 117.75,34.84
PB10: length 27.4
  Top Layer w0.254: v1(96.6,66.64) 96.65,66.69 v1(96.65,69.14) ; 99.13,47.75 97.29,47.75 v1(96.95,48.08)
  Bottom Layer w0.254: v1(96.6,66.64) 96.6,48.44 v1(96.95,48.08) ; v1(96.65,69.14) 96.88,69.36 96.89,69.36 97.28,69.75 97.97,69.75 98.18,69.96 98.18,71.99
PB11: length 32.6
  Top Layer w0.254: 99.09,47.25 99.07,47.27 96.04,47.27 95.58,47.73 v1(95.58,48.59)
  Bottom Layer w0.254: 100.81,72.05 100.68,71.93 100.68,68.19 100.21,67.72 96.1,67.72 95.59,67.21 95.59,48.61 v1(95.58,48.59)
PC13: length 6.1
  Top Layer w0.254: 110.53,54.77 110.17,54.42 105.83,54.42 105.57,54.15 105.57,53.25
RSTN: length 4.2
  Top Layer w0.254: 64.05,43.69 63.95,43.79 63.95,47.8
SCLK: length 29.5
  Top Layer w0.254: 99.08,50.29 86.76,50.29 86.18,49.71 86.18,44.1 85.46,43.38 75.71,43.38
SDI: length 19.9
  Top Layer w0.254: 83.31,46.61 84.44,46.61 84.75,46.92 84.75,50.77 85.27,51.29 99.05,51.29
SDO: length 36.5
  Top Layer w0.254: 99.01,49.75 87.79,49.75 87,48.96 87,43.34 85.91,42.25 70.44,42.25 70.2,42.49 70.2,43.55 70.14,43.62
UA-IN: length 5.1
  Top Layer w1.016: 46.19,2.29 49.42,2.29 50.43,3.31 50.43,3.73
UA-OUT: length 8.3
  Top Layer w1.016: 56.69,11.33 55.59,10.23 55.59,3.5
UB-IN: length 5.4
  Top Layer w1.016: 60.07,2.43 64.03,2.43 64.65,3.05 64.65,3.61
UB-OUT: length 8.6
  Top Layer w1.016: 70.74,11.62 70.74,4.26 69.85,3.37
UC-IN: length 6.1
  Top Layer w1.016: 74.82,2.34 74.86,2.3 79.54,2.3 79.88,2.64 79.88,3.51
UC-OUT: length 8.5
  Top Layer w1.016: 86.04,11.52 84.9,10.37 84.9,3.45
VAN: length 29.3
  Top Layer w0.254: 53.31,36.7 53.4,36.61 C46.1 ; 53.31,36.7 53.31,34.72 53.4,34.63 R41.2 ; 53.31,36.7 53.31,55.12 55.17,56.99 57.83,56.99 58.03,56.79 U17.13
VAP: length 29.7
  Top Layer w0.254: C45.2 52.81,36.61 52.9,36.7 ; 52.9,36.7 52.9,34.72 52.81,34.63 R40.2 ; 52.9,36.7 52.9,55.29 55,57.4 57.83,57.4 58.03,57.59 U17.12
VBN: length 38.9
  Top Layer w0.254: 67.29,36.7 67.29,36.61 C48.1 ; 67.29,36.7 67.29,34.63 R51.2 ; 67.29,36.7 67.29,38.84 66.49,39.63 55.21,39.63 54.55,40.29 54.55,54.31 55.63,55.39 57.83,55.39 58.03,55.19 U17.15
VBP: length 39.7
  Top Layer w0.254: 66.88,36.7 66.88,34.72 66.79,34.63 R50.2 ; 66.88,36.7 66.79,36.61 C47.2 ; 66.88,36.7 66.88,38.67 66.32,39.23 55,39.23 54.15,40.08 54.15,54.48 55.47,55.8 57.83,55.8 58.03,55.99 58.99,55.99
VCN: length 50.8
  Top Layer w0.254: U17.17 58.03,53.59 57.83,53.79 56.1,53.79 55.65,53.35 55.65,41.3 56.06,40.9 81.17,40.9 82.27,39.8 82.27,36.57 ; 82.27,36.57 82.36,36.48 C50.1 ; 82.27,36.57 82.27,34.59 82.36,34.5 R61.2
VCP: length 51.3
  Top Layer w0.254: C49.2 81.77,36.48 81.86,36.57 ; 81.86,36.57 81.86,34.59 81.77,34.5 R60.2 ; 81.86,36.57 81.86,39.63 81,40.49 55.89,40.49 55.25,41.13 55.25,53.52 55.93,54.2 57.83,54.2 58.03,54.39 U17.16
XI: length 14.2
  Top Layer w0.254: 78.93,56.85 78.63,56.55 75.34,56.55 ; 70.4,52 72.51,52 72.98,52.47 72.98,55.98 73.5,56.5 75.32,56.5 ; 78.98,55.04 78.98,56.65
XO: length 10.7
  Top Layer w0.254: 70.42,51.23 74.97,51.23 75.39,51.65 ; 79.03,51.85 78.98,51.8 78.98,53.61 ; 75.29,51.7 78.93,51.7
$1N22559: length 2.5
  Top Layer w0.254: 116.01,47.48 116.01,44.98
$1N22560: length 2.4
  Top Layer w0.254: 118.86,47.46 118.86,45.15 118.82,45.11
$1N22574: length 6
  Top Layer w0.254: 34.82,63.31 34.79,63.28 31.97,63.28 ; 28.84,63.28 31.97,63.28 ; 31.97,63.28 31.99,63.26
$1N22575: length 16.3
  Top Layer w0.254: 22.81,60.99 22.79,61 20.28,61 20.28,64.5 21.73,64.5 22.02,64.79 22.02,65.47 22.29,65.73 23.59,65.73 23.62,65.76 ; 28.84,60.96 22.83,60.96
$1N22612: length 3.7
  Top Layer w0.254: 34.11,72.7 34.11,68.99
$1N22614: length 2.1
  Top Layer w0.254: 6.66,70.75 8.72,70.75 8.73,70.76
$1N22615: length 7.4
  Top Layer w0.254: 10.71,70.71 10.71,68.18 10.72,68.17 ; 10.71,70.71 10.7,70.72 10.7,71.51 11.08,71.88 14.53,71.88 ; 10.71,70.71 10.71,70.75
$1N22617: length 3.9
  Top Layer w0.254: 12.9,68.15 14.14,68.15 14.52,68.52 14.52,70.63 14.5,70.65
$1N22619: length 3.7
  Top Layer w0.254: 16.19,76.83 16.19,75.01 15.61,74.43 14.55,74.43 14.54,74.45
$1N22620: length 7.5
  Top Layer w0.254: 21.45,73.8 21.45,72.27 21.05,71.87 19.95,71.87 ; 21.45,73.8 21.44,73.8 ; 21.45,73.8 21.45,75.41 21.74,75.7 22.66,75.7 ; 21.45,73.8 21.82,74.17 22.66,74.17
$1N22621: length 2.3
  Top Layer w0.254: 26.01,75.72 26,75.71 23.75,75.71
$1N22623: length 4.8
  Top Layer w0.254: 19.94,70.62 22.37,70.62 ; 22.37,70.62 22.68,70.31 22.68,69.74 ; 22.37,70.62 22.81,71.06 22.81,71.82
$1N22626: length 9.9
  Top Layer w0.254: 18.14,80.11 21.19,80.11 ; 18.2,79.98 18.14,79.92 18.14,76.87 ; 18.24,76.74 18.27,76.77 18.27,75.01 18.87,74.42 19.96,74.42
$1N22649: length 10.3
  Top Layer w1.016: 17.16,63.14 17.16,53.59 16.63,53.05
$1N22650: length 20.6
  Top Layer w0.254: 112.95,71.85 112.95,69.1 113.36,68.68 115.36,68.68 115.81,68.23 115.81,55.49 115.32,55 114.53,55 114.23,54.69
$1N22653: length 2.8
  Top Layer w0.254: 110.59,52.73 113.27,52.73 113.34,52.79
$1N22719: length 7
  Top Layer w0.254: 113.46,48.6 113.5,48.63 113.5,49.51 113.24,49.76 107.55,49.76
$2N4939: length 1.9
  Top Layer w1.016: 46.24,3.81 46.24,5.69 46.21,5.72
$2N4942: length 1.9
  Top Layer w1.016: 46.11,9.11 46.24,8.98 46.24,7.23
$2N4945: length 1.8
  Top Layer w1.016: 46.16,10.69 46.16,12.48 46.19,12.5
$2N4948: length 1.8
  Top Layer w1.016: 46.21,14.26 46.21,16.05 46.19,16.07
$2N4951: length 1.9
  Top Layer w1.016: 46.17,17.51 46.2,17.54 46.2,19.4
$2N4958: length 7.5
  Top Layer w1.016: 56.69,27.84 56.64,27.79 55.08,27.79 54.36,28.51 54.36,31.43 ; 54.44,33.09 54.44,31.14
$2N5672: length 1.9
  Top Layer w1.016: 59.93,5.75 59.9,5.72 59.9,3.86
$2N5674: length 1.8
  Top Layer w1.016: 60,7.28 60,9.07 59.97,9.11
$2N5676: length 2
  Top Layer w1.016: 59.97,12.64 59.98,12.62 59.98,10.63
$2N5678: length 1.8
  Top Layer w1.016: 60.02,15.97 59.95,15.91 59.95,14.17
$2N5680: length 1.8
  Top Layer w1.016: 59.98,17.52 59.98,19.29 59.93,19.34
$2N6267: length 1.7
  Top Layer w1.016: 74.75,3.92 74.75,5.62
$2N6269: length 1.9
  Top Layer w1.016: 74.79,9.24 74.75,9.2 74.75,7.35
$2N6271: length 1.9
  Top Layer w1.016: 74.79,12.59 74.75,12.55 74.75,10.67
$2N6273: length 1.8
  Top Layer w1.016: 74.75,14.06 74.75,15.91
$2N6275: length 1.8
  Top Layer w1.016: 74.75,17.72 74.82,17.79 74.82,19.53
$2N11088: length 7.2
  Top Layer w1.016: 49.57,27.71 50.97,27.71 52.02,28.75 52.02,33 51.94,33.07
$2N11115: length 12.4
  Top Layer w1.016: 46.27,20.98 48.86,20.98 49.53,20.3 49.53,11.5 49.57,11.45
$2N11127: length 7.7
  Top Layer w1.016: 68.38,33.12 68.38,31.39 ; 68.38,31.39 68.38,28.23 68.89,27.71 70.8,27.71 70.81,27.73 ; 68.38,31.39 68.4,31.37 68.4,31.42 68.42,31.45
$2N11134: length 7.2
  Top Layer w1.016: 63.66,27.73 63.7,27.77 65.13,27.77 65.65,28.29 65.65,31.4 ; 65.65,31.4 65.67,31.39 ; 65.65,31.4 65.65,33.22
$2N11141: length 12.7
  Top Layer w1.016: 63.57,11.43 63.63,11.5 63.63,20.2 62.74,21.08 60.07,21.08
$2N11154: length 6.9
  Top Layer w1.016: 80.59,32.95 80.59,31.29 80.61,31.26 80.61,28.13 80.16,27.67 78.81,27.67 78.78,27.7
$2N11165: length 7.4
  Top Layer w1.016: 86.01,27.76 84.2,27.76 83.69,28.27 83.69,31.31 ; 83.69,32.92 83.69,31.31 ; 83.69,31.31 83.55,31.17
$2N11172: length 13.1
  Top Layer w1.016: 74.79,20.93 78.07,20.93 78.8,20.2 78.8,11.5 78.72,11.42
$2N20660: length 12.1
  Top Layer w0.254: U17.3 67.13,60.57 67.31,60.75 C26.1 75.9,60.79 C28.1

## Copper pours and planes (outline as drawn; the poured copper is in the pictures)
GND on Top Layer: 0.72,84.45 120.61,84.45 120.61,0.76 0.72,0.76
GND on Bottom Layer: 0.72,84.45 120.61,84.45 120.61,0.76 0.72,0.76

Small or netless copper shapes (teardrops, artwork), in the pictures only: 246 on Top Layer, 26 on Bottom Layer

## Text on the board
Top Silkscreen Layer: VIN | GND | NBRX | NBTX | PWR | + | - | CLK | DIO | 3V3 | RXD | TXD | IN | IC | UA | IB | IA | UB | UC
